# EasyEDA Pro project EKOPARTY_FINAL.eprj, board PCB1 (continued)
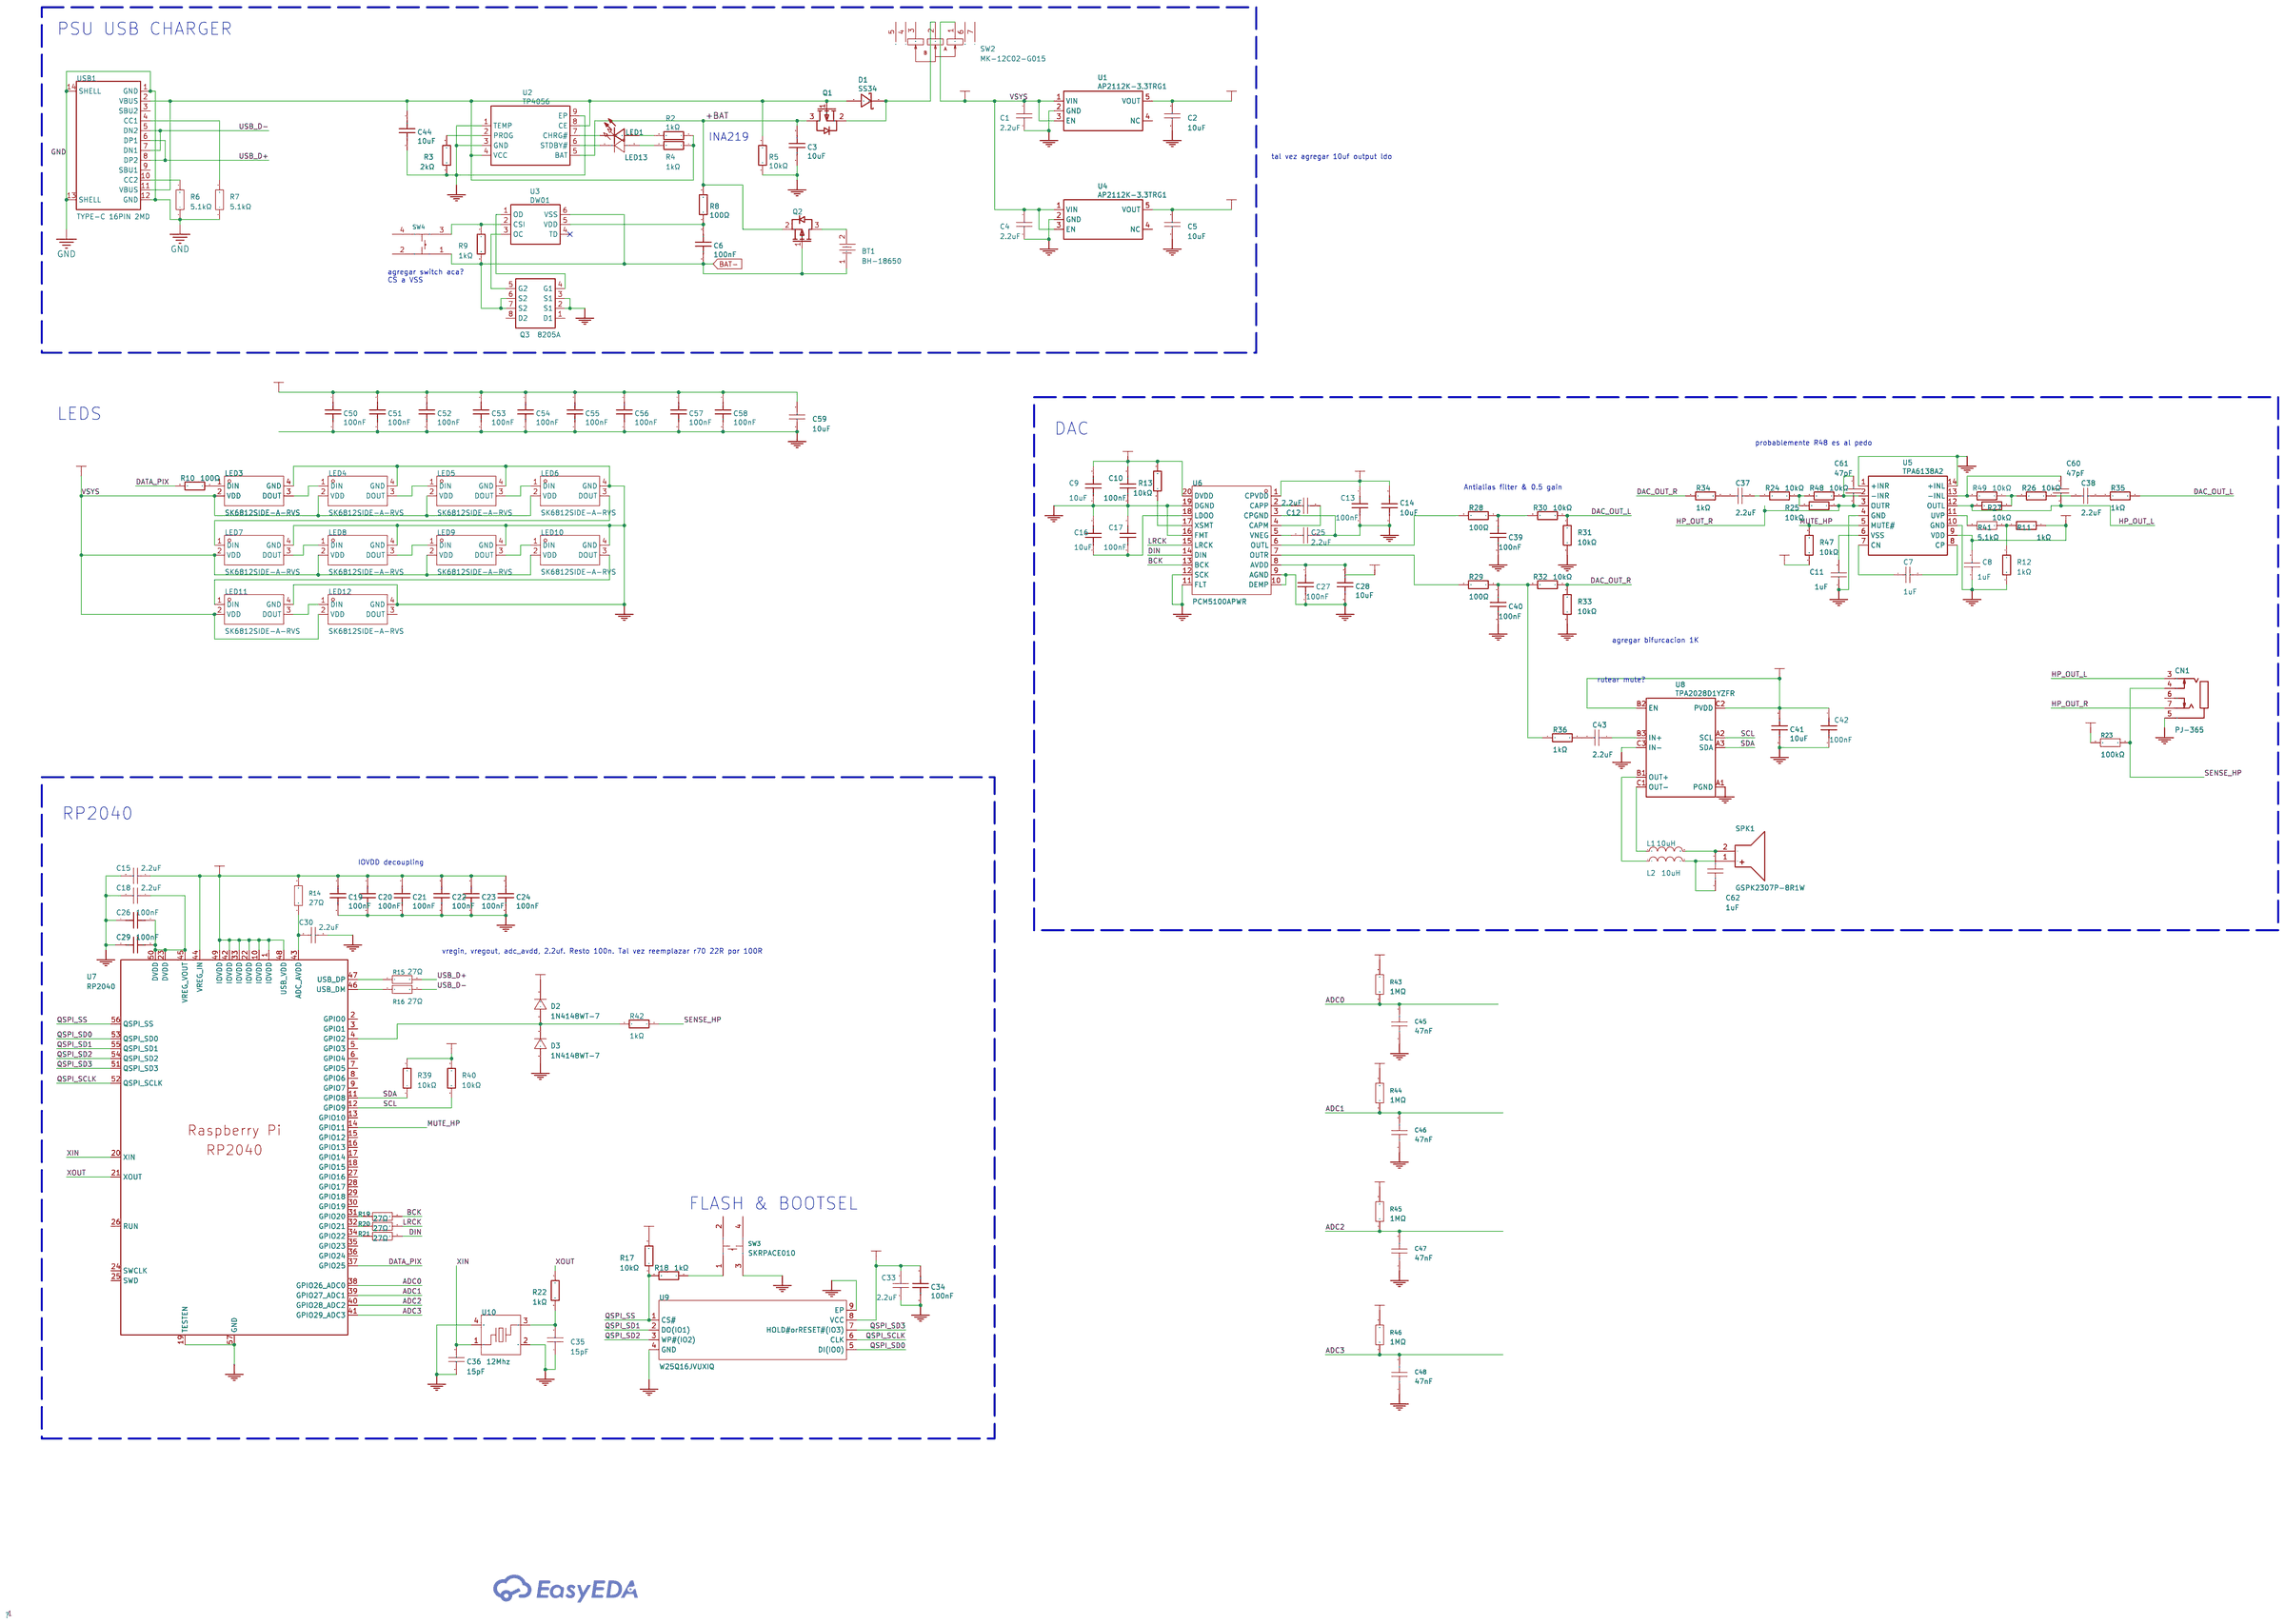
[diagram p0: schematic sheet]
## Nets
As in the schematic, except:
3.3V: C2.1 C9.2 C10.1 C13.1 C14.2 C15.1 C19.1 C20.1 C21.1 C22.1 C23.1 C24.1 C33.1 C34.1 D2.1 NOREF.TP1 R13.2 R14.2 R17.2 R23.2 R39.2 R40.1 R43.2 R44.2 R45.2 R46.2 R47.2 U1.5 U6.1 U6.20 U7.1 U7.10 U7.22 U7.33 U7.42 U7.44 U7.48 U7.49 U9.8
3.3VA: C5.1 C8.2 C27.1 C28.2 C41.2 C42.1 NOREF#7.TP2 NOREF#11.TP1 NOREF#16.TP2 R11.1 U4.5 U5.9 U6.8 U8.B2 U8.C2
GND: C1.2 C2.2 C3.1 C4.2 C5.2 C8.1 C9.1 C10.2 C11.1 C13.2 C14.1 C15.2 C16.2 C17.1 C18.2 C19.2 C20.2 C21.2 C22.2 C23.2 C24.2 C25.2 C26.1 C27.2 C28.1 C29.1 C30.1 C33.2 C34.2 C35.1 C36.1 C39.2 C40.2 C41.1 C42.2 C44.2 C45.1 C46.1 C47.1 C48.1 C50.2 C51.2 C52.2 C53.2 C54.2 C55.2 C56.2 C57.2 C58.2 C59.2 CN1.5 D3.2 LED3.4 LED4.4 LED5.4 LED6.4 LED7.4 LED8.4 LED9.4 LED10.4 LED11.4 LED12.4 NOREF#4.TP4 NOREF#20.TP7 Q3.2 Q3.3 R3.1 R5.1 R6.1 R7.1 R12.2 R31.2 R33.2 SW3.3 U1.2 U2.1 U2.3 U2.9 U4.2 U5.1 U5.4 U5.10 U5.14 U6.3 U6.9 U6.10 U6.11 U6.12 U6.16 U6.19 U7.19 U7.57 U8.A1 U8.C3 U9.4 U9.9 U10.2 U10.4 USB1.1 USB1.12 USB1.13 USB1.14
ADC0: C45.2 NOREF#21.TP8 NOREF#22.TP11 R43.1 U7.38
ADC1: C46.2 NOREF#12.TP15 R44.1 U7.39
ADC2: C47.2 NOREF#3.TP9 NOREF#23.TP9 R45.1 U7.40
ADC3: C48.2 NOREF#14.TP14 R46.1 U7.41
BCK: NOREF#2.TP5 R19.2 U6.13
DAC_OUT_L: NOREF#5.TP8 R30.1 R31.1 R35.2
DAC_OUT_R: NOREF#15.TP8 R32.1 R33.1 R34.1
DIN: NOREF#19.TP7 R21.2 U6.14
LRCK: NOREF#17.TP6 R20.2 U6.15
SCL: NOREF#18.TP9 R40.2 U7.12 U8.A2
SDA: NOREF#6.TP9 R39.1 U7.11 U8.A3
USB_D+: NOREF#10.TP1 R15.2 USB1.6 USB1.8
USB_D-: NOREF#13.TP2 R16.2 USB1.5 USB1.7
VSYS: C1.1 C4.1 C50.1 C51.1 C52.1 C53.1 C54.1 C55.1 C56.1 C57.1 C58.1 C59.1 LED3.2 LED4.2 LED5.2 LED6.2 LED7.2 LED8.2 LED9.2 LED10.2 LED11.2 LED12.2 NOREF#9.TP3 SW2.1 U1.1 U1.3 U4.1 U4.3
$1N11709: C40.1 NOREF#8.TP3 R29.1 R32.2 R36.1

Pads without a net: CN1 6; LED12 3; Q3 1 8; SW2 3 4 5 6 7; SW3 2 4; SW4 2 4; U1 4; U3 4; U4 4; U7 2 3 5 6 7 8 9 13 15 16 17 18 24 25 26 27 28 29 30 35 36; USB1 3 9

## Via types
v1: diameter 0.45, hole 0.3, Top Layer to Bottom Layer, 66 vias
v2: diameter 0.45, hole 0.2, Top Layer to Bottom Layer, 81 vias
v3: diameter 0.61, hole 0.305, Top Layer to Bottom Layer, 106 vias
v4: diameter 1, hole 0.5, Top Layer to Bottom Layer, 4 vias
v5: diameter 0.8, hole 0.4, Top Layer to Bottom Layer, 2 vias

## Routing (per net, layer and track width the routed paths; a pad name or vN(x,y) marks a point on that pad's centre or on a via; arc(x,y) is an arc through that point)
3.3V: length 172.5
  Inner1 w0.127: v2(86.06,77.14) 83.39,74.47 v2(82.12,74.47) ; v3(77.42,83.49) 77.42,81.08 v3(77.04,80.7) ; v2(87.45,71.59) 87.45,70.17 ; v2(92.15,72.06) 91.43,72.79 v4(91.43,73.59)
  Inner1 w0.5: v3(37.38,75.49) 41.19,71.68 58.75,71.68 59.77,70.66
  Inner1 w0.8: 78.27,70.28 77.78,70.78 59.88,70.78 59.77,70.66
  Inner1 w1: 78.27,70.28 v4(78.56,70.58) 78.99,70.16 88,70.16 v4(91.43,73.59)
  Inner2 w0.127: v2(93.55,84.38) 93.55,77.9 v3(92.15,76.51)
  Bottom Layer w0.127: 84.7,78.16 84.79,78.25 85,78.25 85.04,78.28 ; 84.7,78.16 84.55,78.31 84.55,78.67 84.43,78.79 80.98,78.79 80.6,78.41 v2(80.6,78.28) 80.41,78.1 U7.1 77.65,78.1 C19.1 ; 84.7,78.16 U7.44 84.7,76.47 85.04,76.13 86.25,76.13 86.25,76.1 C15.1 87.29,75.24 R14.2 ; 85.28,81.7 85.04,81.46 85.04,78.28 ; 85.28,81.7 85.18,81.7 84.28,82.6 82.88,82.6 82.63,82.86 82.63,83.24 82.7,83.31 U7.22 82.7,86.23 83.14,86.67 84.84,86.67 85.55,87.39 ; 85.28,81.7 U7.33 86.07,81.71 87.54,81.71 ; v2(92.15,72.06) 92.59,71.63 92.59,71.25 ; C20.1 77.2,82.18 76.71,82.68 R39.2 ; U7.49 82.75,77.1 82.75,75.95 ; v2(82.12,74.47) 81.96,74.47 C23.1 81.87,75.07 82.75,75.95 ; v2(86.06,77.14) 87.04,77.14 C24.1 ; 77.59,81.71 77.6,81.7 U7.10 ; 82.75,75.95 83.1,76.3 U7.48 ; C33.1 76.78,72.82 U9.8 ; R46.2 v2(87.45,71.59) ; 87.54,77.78 86.37,77.78 U7.42 85.98,78.03 85.3,78.03 85.04,78.28 ; v3(77.42,83.49) 77.42,83.95 R40.1 ; U1.5 92.89,75.77 v3(92.15,76.51) ; R43.2 94.26,83.92 93.8,84.38 v2(93.55,84.38) ; R47.2 74.26,83.15 D2.1 74.26,81.44 74.77,80.94 74.77,80.61 R23.2 75.19,80.7 v3(77.04,80.7) 77.19,80.54 77.59,80.54
  Bottom Layer w0.25: 77.59,81.71 77.59,80.54 77.3,80.26 77.3,78.31 C19.1 ; C10.1 32.96,77.75 C9.2 32.93,78.78 U6.20 31.75,78.79 R13.2 30.69,77.72 30.69,77.27 30.51,77.09 28.53,77.09 28.35,77.27 28.35,78.59 28.15,78.79 27.18,78.79 U6.1 25.39,78.79 C13.1 C14.2 ; R45.2 92.62,75.57 U1.5
  Bottom Layer w0.254: R17.2 75.52,72.91 C33.1 C34.1 ; v2(87.45,71.59) 88.38,71.59 NOREF.TP1
  Bottom Layer w0.5: C10.1 32.96,76.13 33.61,75.49 v3(37.38,75.49) ; v4(78.56,70.58) 78.1,71.05 76.02,71.05 75.52,71.55 C34.1 ; R14.2 88.16,74.65 89.23,73.59 v4(91.43,73.59) 92.89,75.04 U1.5 93.51,75.92 C2.1
3.3VA: length 67.5
  Inner1 w0.5: v3(37.54,86.16) 36.78,86.92 36.78,89.33 35,91.11 27.13,91.11 v3(26.88,90.86) 26.24,90.22 26.24,89.59 14.81,78.16 v3(14.81,73.46)
  Bottom Layer w0.127: U8.B2 U8.C2 41.35,86.79 ; R11.1 14.43,73.08 v3(14.81,73.46) 15.57,72.7 C8.2 15.89,72.92 U5.9
  Bottom Layer w0.25: U4.5 29.61,84.45 28.5,83.34 U6.8 27.15,83.36 26.15,83.36 C28.2 C27.1
  Bottom Layer w0.254: 39.74,86.06 39.74,85.61 NOREF#16.TP2 ; NOREF#11.TP1 37.92,85.78 v3(37.54,86.16) ; NOREF#7.TP2 v3(26.88,90.86) ; v3(41.86,86.16) 41.35,86.67 41.35,86.79
  Bottom Layer w0.5: v3(37.54,86.16) 38.58,86.16 38.68,86.06 41.76,86.06 v3(41.86,86.16) 41.86,85.69 41.23,85.05 C42.1 ; v3(26.88,90.86) 27,90.86 27,86.92 27.55,86.38 C5.1 29.49,86.38 U4.5
GND: length 32.8
  Top Layer w0.127: v2(49.23,21.13) 49.61,20.75 49.61,20.37 ; v2(46.31,17.83) 46.94,17.2 ; v2(44.41,17.58) 45.04,17.58 ; v2(59.9,21.13) 59.9,21.01 59.26,20.37 ; 59.9,25.2 59.9,23.83 v2(59.88,23.81) ; v2(62.94,17.71) 62.18,16.94 61.93,16.94
  Bottom Layer w0.127: v3(95.58,70.03) 95.58,68.15 94.91,67.48 ; 86.88,85.78 86.95,85.85 86.95,87.39 ; v3(21.03,73.97) 21.29,74.22 U5.4 ; C35.1 83.59,91.07 82.2,91.07 ; U5.14 17.14,76.13 v3(18.49,76.13) ; 80.72,80.7 v3(81.48,80.7) U7.57 ; U5.1 22.57,76.05 v3(21,76.05) ; U10.4 79.76,89.13 C36.1 ; U7.19 81.5,82.86
  Bottom Layer w0.25: USB1.12 50.81,6.83 USB1.14 ; U7.19 81.5,85.38 79.71,87.17 79.71,87.8 C36.1 ; USB1.13 58.34,7.38 USB1.1 ; 88.63,77.78 C30.1 89.55,76.63 v3(89.67,76.52) ; U6.12 U6.11
  Bottom Layer w0.254: Q3.2 84.1,43.87
  vias: v1(41.99,100.76) v1(42.88,100.76) v1(43.39,84.38) v1(43.51,89.21) v1(43.77,90.86) v1(44.02,83.49) v1(44.27,86.29) v1(44.4,92.89) v1(45.04,85.65) v1(45.04,82.73) v1(45.29,94.79) v1(46.05,82.22) v1(46.56,96.32) v1(46.56,81.46) v1(46.81,82.22) v1(47.45,84.38) v1(47.65,82.22) v1(48.08,97.59) v1(48.45,100.89) v1(48.47,82.22) v1(48.72,79.68) v1(49.74,98.6) v1(50.18,100.89) v1(50.37,78.79) v1(51.13,99.24) v1(52.05,100.89) v1(52.28,78.16) v1(53.33,99.87) v1(53.97,100.89) v1(54.56,82.35) v1(54.69,84.38) v1(54.82,77.9) v1(55.32,99.87) v1(55.83,84.51) v1(55.83,82.35) v1(55.88,100.89) v1(56.59,85.14) v1(56.85,82.48) v1(57.1,99.62) v1(57.61,86.16) v1(57.74,83.11) v1(57.74,78.28) v1(57.79,100.89) v1(58.5,87.05) v1(58.63,99.11) v1(58.63,84) v1(59.13,100.89) v1(59.64,85.02) v1(59.77,79.05) v1(60.02,98.48) v1(60.66,87.31) v1(60.66,86.03) v1(60.78,100.89) v1(61.67,80.32) v1(61.93,97.08) v1(62.94,96.19) v1(63.2,81.84) v1(63.83,94.92) v1(64.47,83.75) v1(64.59,93.52) v1(65.23,85.52) v1(65.36,91.75) v1(65.61,87.3) v1(65.74,89.59) v1(66.75,100.76) v1(68.53,100.76) v2(3.89,63.17) v2(5.29,54.79) v2(8.18,39.42) v2(9.03,39.42) v2(9.35,27.23) v2(9.98,75.49) v2(13.67,84.25) v2(14.68,20.75) v2(21.92,93.52) v2(22.3,42.47) v2(30.18,71.93) v2(33.1,100) v2(36.15,45.26) v2(44.15,45.26) v2(45.67,72.57) v2(46.18,2.72) v2(49.99,96.19) v2(53.55,72.44) v2(55.2,80.95) v2(57.48,46.28) v2(60.15,95.81) v2(62.56,71.55) v2(63.58,85.65) v2(63.91,2.63) v2(65.36,96.83) v2(69.04,78.28) v2(69.8,71.68) v2(72.34,84.51) v2(76.79,91.24) v2(76.79,90.22) v2(76.79,89.16) v2(77.17,92.38) v2(77.93,92.89) v2(78,89.16) v2(78.83,92.89) v2(79.33,86.41) v2(79.84,92.89) v2(80.34,85.78) v2(80.85,92.89) v2(83.39,10.21) v2(84.28,88.57) v2(85.2,88.57) v2(85.68,94.29) v2(85.68,89.97) v2(85.8,88.95) v2(86.44,93.65) v2(87.2,93.02) v2(97.36,22.79) v3(20.65,80.44) v3(24.46,83.24) v3(34.11,84) v3(42.62,103.56) v3(44.2,103.56) v3(63.45,40.95) v3(66.12,103.68) v3(66.52,41.07) v3(66.84,37.01) v3(67.4,41.07) v3(67.47,103.68) v3(68.28,41.07) v3(79.05,75.85) v3(79.83,72.57) v3(81.49,81.84) v3(81.49,79.68) v3(82.43,81.84) v3(82.43,80.7) v3(82.43,79.67) v3(83.4,81.85) v3(83.4,80.7) v3(83.4,79.65) v3(86.18,41.07) v3(87.33,73.2) v3(96.6,34.6) v3(99.42,70.03)
+BAT: length 48.3
  Bottom Layer w0.127: U2.5 65.42,43.89
  Bottom Layer w0.5: 63.92,43.61 62.94,43.61 ; U2.5 65.05,43.65 63.96,43.65
  Bottom Layer w0.6: Q2.2 74.39,40.12 R8.2
  Bottom Layer w1: 72.34,34.91 71.74,34.3 63.54,34.3 62.24,35.61 62.24,42.91 62.94,43.61 ; 72.34,34.91 73.05,35.61 73.05,40.08 Q2.2 ; 72.34,34.91 72.34,34.34 85.15,34.34 87.34,36.53 Q1.3 ; 63.96,43.65 63.92,43.61
ADC0: length 78.8
  Top Layer w0.254: 101.68,25.2 101.68,25.71 v3(100.15,27.23)
  Inner1 w0.2: 96.56,78.28 96.11,78.73 v2(93.11,78.73)
  Inner1 w0.25: v3(95.71,80.82) 96.56,79.98
  Inner1 w0.254: 96.56,79.98 96.56,78.28
  Inner1 w0.5: 96.56,78.28 98.25,78.28 104.6,71.93 104.6,34.47 103.71,33.58 v3(102.44,33.58)
  Bottom Layer w0.127: v2(93.11,78.73) 92.79,79.05 91.86,79.05 91.48,79.43 87.84,79.43 87.57,79.7 U7.38 ; R43.1 95.71,82.78 v3(95.71,80.82) ; NOREF#22.TP11 NOREF#21.TP8
  Bottom Layer w0.5: NOREF#22.TP11 101.04,29.3 101.04,28.12 v3(100.15,27.23) ; C45.2 95.62,80.91 v3(95.71,80.82) ; NOREF#21.TP8 v3(102.44,33.58)
ADC1: length 87.9
  Top Layer w0.127: v2(59.92,26.13) 59.92,27.96 59.77,28.12 ; v2(53.16,26.34) 53.16,27.87
  Inner1 w0.25: 60.26,26.47 63.45,26.47
  Inner1 w0.254: 60.26,26.47 v2(59.92,26.13) 59.71,26.34 v2(53.16,26.34)
  Inner1 w0.5: 63.45,26.47 v2(64.55,26.47)
  Inner2 w0.25: v2(90.88,78.16) 90.38,77.65 90.38,74.31
  Inner2 w0.5: v2(64.55,26.47) 65.48,26.47 87.96,48.95 87.96,62.92 90.38,65.33 v2(90.38,70.54) 90.38,72.86 89.95,73.29 89.95,73.88 90.38,74.31
  Bottom Layer w0.127: 91.77,78.28 91.65,78.16 v2(90.88,78.16) 90.88,78.28 90.12,79.05 87.84,79.05 87.58,79.3 U7.39 ; v2(90.38,70.54) 91.09,70.54 R44.1
  Bottom Layer w0.25: C46.2 91.72,70.81 R44.1
ADC2: length 155.6
  Top Layer w0.254: 25.73,11.1 22.68,8.05 21.8,8.05
  Inner2 w0.5: v3(30.3,11.1) 62.82,11.1 67.77,6.15 77.17,6.15 103.46,32.44 103.46,68.89 100.67,71.67 100.45,71.67 100.14,71.97 100.14,72.2 v3(98.25,74.09) v3(94.57,77.78)
  Bottom Layer w0.127: U7.40 87.66,78.9 87.79,78.77 89.43,78.77 90.93,77.27 92.53,77.27 93.04,77.78 v3(94.57,77.78) ; NOREF#23.TP9 NOREF#3.TP9
  Bottom Layer w0.25: R45.1 91.26,77.25 91.25,77.27 ; v3(98.25,74.09) 97.78,73.62 C47.2
  Bottom Layer w0.5: NOREF#3.TP9 v3(30.3,11.1)
  vias: v3(25.86,11.1)
ADC3: length 103
  Top Layer w0.127: 52.78,18.47 52.15,17.83 v2(51.51,17.83)
  Top Layer w0.25: 54.56,16.69 54.56,18.72
  Inner1 w0.127: 51.39,17.96 v2(51.51,17.83)
  Inner1 w0.254: 50.24,25.83 51.39,24.69 51.39,17.96
  Inner1 w0.5: v3(64.34,30.91) 64.34,29.97 62.74,28.37 51.26,28.37 50.24,27.36 50.24,25.83
  Inner2 w0.5: 84.53,71.55 v2(85.17,71.55) ; 84.53,71.55 84.53,74 88.12,77.59 v2(89.77,77.59) ; 84.53,71.55 v2(84.53,69.01) 84.53,67.36 v2(84.15,66.98) 83.14,65.97 76.91,65.97 76.41,65.46 76.41,54.79 78.82,52.38 78.82,48.57 72.98,42.72 72.98,37.9 72.38,37.3 72.38,36.68 66.62,30.91 v3(64.34,30.91)
  Bottom Layer w0.127: C48.2 85.75,69.01 v2(84.53,69.01) ; NOREF#14.TP14 85.3,66.98 v2(84.15,66.98) ; v2(89.77,77.59) 88.95,78.41 87.07,78.41 86.99,78.5 U7.41 ; R46.1 85.9,71.55 v2(85.17,71.55)
BAT-: length 88.3
  Inner1 w1: 71.33,42.34 v3(56.21,42.34)
  Inner1 w2: v3(56.21,42.34) 47.2,42.34 31.7,26.85 19.69,26.85 BT1.1 ; v3(71.58,42.09) 75.52,38.15 v3(79.07,38.15)
  Bottom Layer w0.127: Q3.7 84.1,38.02
  Bottom Layer w0.25: SW4.1 59.46,40.75 57.86,42.34 v3(56.21,42.34)
  Bottom Layer w0.5: 74.51,42.39 74.4,42.5 74.75,42.85 76.59,42.85 77.29,42.15 77.5,42.36 R9.2 ; 74.51,42.09 74.51,41.89 ; Q2.1 73.02,42.09 v3(71.58,42.09)
  Bottom Layer w1: Q2.1 74.05,42.02 74.25,42.22 ; 83.78,38.02 83.78,36.13
  Bottom Layer w1.5: 83.64,36.25 83.52,36.12 81.74,36.12 79.74,38.12 v3(79.74,38.15)
  Bottom Layer w2: v3(79.07,38.15) v3(79.74,38.15)
  vias: v3(55.7,42.99) v3(55.7,41.71) v3(70.82,42.09) v3(71.58,42.85) v3(79.07,38.91) v3(79.07,37.39)
BCK: length 88.8
  Inner1 w0.25: v3(90.38,85.52) 90.38,92.64 86.44,96.57 v3(83.26,96.57)
  Bottom Layer w0.25: v3(90.38,85.52) 90.38,85.47 R19.2 ; v3(83.26,96.57) 76.86,102.98 40.01,102.98 36.4,99.37 36.4,84.51 35.26,83.36 32.95,83.36 U6.13
  Bottom Layer w0.254: v3(90.38,85.52) 89.99,85.9 NOREF#2.TP5
DAC_OUT_L: length 5
  Bottom Layer w0.25: R30.1 18.57,82.48 R31.1 R35.2
  Bottom Layer w0.254: R35.2 15.14,82.27 NOREF#5.TP8
DAC_OUT_R: length 10.2
  Inner2 w0.25: v3(17.1,84.25) 19.76,81.59 v3(19.76,79.68)
  Bottom Layer w0.25: R32.1 R33.1 17.1,84.81 v3(17.1,84.25) ; R34.1 19.76,78.95 v3(19.76,79.68)
  Bottom Layer w0.254: NOREF#15.TP8 16.59,85.47 R33.1
DATA_PIX: length 6.3
  Bottom Layer w0.127: U7.37 87.55,80.1 87.84,79.81 R10.2
DIN: length 99.4
  Inner2 w0.25: v3(92.92,80.7) 92.92,89.07 79.44,102.54 38.18,102.54 36.02,100.38 36.02,87.81 33.31,85.1 32.04,85.1 31.91,84.97 31.41,84.97 31.14,84.7 v3(31.14,83.02)
  Bottom Layer w0.127: R21.2 89.03,80.7 v3(92.92,80.7) ; v3(31.14,83.02) 31.47,82.69 32.92,82.69
  Bottom Layer w0.254: NOREF#19.TP7 92.92,80.82 v3(92.92,80.7)
HP_OUT_L: length 65.1
  Inner2 w0.25: v3(11.25,37.9) 11.25,38.41 6.05,43.61 5.03,43.61 2.24,46.41 2.24,66.73 6.56,71.05 16.21,71.05 18.75,73.59 v3(18.75,74.35)
  Bottom Layer w0.127: 17.89,77.48 18.41,77.48 19.38,76.51 19.38,74.98 v3(18.75,74.35)
  Bottom Layer w0.25: v3(11.25,37.9) 11.25,37.77 12.63,36.4 CN1.3 ; v3(18.75,74.35) 18.22,74.87 15.26,74.87 R27.2
HP_OUT_R: length 62.8
  Inner1 w0.25: v3(3.44,48.12) 2.75,48.82 2.75,66.22 8.21,71.68 17.34,71.68 v3(20.53,74.87)
  Bottom Layer w0.127: C61.1 26.06,72.7 25.3,73.46 R25.1
  Bottom Layer w0.25: v3(20.53,74.87) 24.65,74.87 R25.1 ; v3(3.44,48.12) 3.44,44.95 6.81,41.58 11.64,41.58 13.03,42.98 CN1.7
LRCK: length 91.6
  Inner2 w0.25: v3(91.15,82.96) 91.8,83.61 91.8,85.77 92.28,86.25 92.28,88.7 80.36,100.62 79.37,100.62 79.31,100.56 78.83,100.56 77.99,101.4 39.08,101.4 36.78,99.1 36.78,82.98 35.89,82.09 v3(35,82.09)
  Bottom Layer w0.25: v3(35,82.09) 32.98,82.09 U6.15 ; v3(91.15,82.96) R20.2
  Bottom Layer w0.254: NOREF#17.TP6 v3(91.15,82.96)
MUTE_HP: length 64
  Inner1 w0.127: v2(24.21,73.59) 24.22,73.57 v2(30.26,73.57) ; v2(73.23,84.13) 73.6,84.49 75.99,84.49 76.29,84.8 76.29,85.03 76.66,85.4 v2(78.82,85.4)
  Inner1 w0.25: v3(40.72,73.59) 40.97,73.33 58.37,73.33 68.28,83.24 v3(71.71,83.24)
  Bottom Layer w0.127: U5.5 22.71,73.59 v2(24.21,73.59) ; v2(78.82,85.4) 78.95,85.26 U7.14 ; v2(73.23,84.13) 73.23,83.42 R47.1 73.05,83.24 v3(71.71,83.24)
  Bottom Layer w0.254: v3(40.72,73.59) 40.7,73.57 v2(30.26,73.57)
QSPI_SCLK: length 7.4
  Bottom Layer w0.127: U9.6 77.8,72.45 78.06,72.19 78.44,72.19 78.69,72.44 78.69,73.46 81.5,76.27 U7.52
QSPI_SD0: length 5.5
  Bottom Layer w0.127: U7.53 81.1,76.25 78.31,73.46 78.31,72.85 U9.5
QSPI_SD1: length 4.6
  Bottom Layer w0.127: U7.55 80.3,76.47 80.09,76.25 79.71,76.25 79.2,76.76 77.81,76.76 77.3,76.25 U9.2
QSPI_SD2: length 4.3
  Bottom Layer w0.127: U7.54 80.62,77.06 80.62,76.46 80.18,76.02 79.61,76.02 79.26,76.38 77.93,76.38 77.8,76.25 U9.3
QSPI_SD3: length 8.4
  Bottom Layer w0.127: U7.51 81.9,76.29 78.92,73.31 78.92,72.35 78.51,71.93 77.8,71.93 77.3,72.44 U9.7
QSPI_SS: length 6.8
  Bottom Layer w0.127: R18.2 75.52,76.05 R17.1 75.85,74.91 U9.1 76.79,75.87 76.79,76.25 77.68,77.15 U7.56
SCL: length 72.3
  Inner1 w0.25: v3(41.35,99.11) 41.35,103.68 42.24,104.57 67.77,104.57 70.18,102.16 70.18,89.33 74.5,85.02 v3(75.77,85.02)
  Bottom Layer w0.127: R40.2 75.82,85.07 v3(75.77,85.02) ; U8.A2 41.35,89.33
  Bottom Layer w0.25: 41.35,89.33 v3(41.35,99.11) ; U7.12 78.18,82.5 78.09,82.59 78.09,84.47 77.5,85.07 R40.2
  Bottom Layer w0.5: v3(75.77,85.02) 75.77,85.78 NOREF#18.TP9
SDA: length 67.4
  Bottom Layer w0.127: U8.A3 40.85,88.32 40.85,89.59
  Bottom Layer w0.25: 72.88,88.09 72.88,86.69 R39.1 76.33,83.24 76.79,83.24 77.93,82.1 U7.11 ; 40.85,89.59 40.11,90.32 v3(40.11,96.83)
  Bottom Layer w0.254: v3(40.11,96.83) 40.08,96.85 40.08,100.89 41.1,101.91 69.67,101.91 72.88,98.7 72.88,88.09
SENSE_HP: length 112.8
  Bottom Layer w0.127: R42.2 73.05,80.44 R23.1
  Bottom Layer w0.25: CN1.4 2.62,41.68 2.62,67.62 4.9,69.9 46.69,69.9 50.62,73.84 62.44,73.84 69.17,80.57 72.77,80.57 R42.2
USB_D+: length 95.9
  Bottom Layer w0.127: USB1.8 53.81,8.19 53.93,8.31 54.43,8.31 54.81,7.93
  Bottom Layer w0.254: 54.86,12.55 54.86,37.03 53.39,38.49 53.39,51.66 55.68,53.94 55.68,55.34 56.81,56.47 56.81,64.15 56.31,64.65 56.31,65.88 60.24,69.8 82.76,69.8 83.57,70.62 83.57,73.14 R15.2 ; 54.86,12.55 54.86,8.23 54.81,8.18 USB1.6 ; 54.86,12.55 NOREF#10.TP1
USB_D-: length 96.6
  Bottom Layer w0.127: USB1.5 55.31,6.64 55.07,6.4 54.43,6.4 54.31,6.53 54.31,7.38 USB1.7
  Bottom Layer w0.254: 55.26,12.55 55.26,37.2 53.8,38.66 53.8,51.49 56.09,53.77 56.09,55.17 57.22,56.31 57.22,64.32 56.72,64.82 56.72,65.71 60.4,69.39 82.92,69.39 83.98,70.45 83.98,73.14 R16.2 ; 55.26,12.55 NOREF#13.TP2 ; 55.26,12.55 55.26,8.23 55.31,8.18 USB1.5
VSYS: length 218
  Inner1 w0.8: v4(102.19,68.76) 101.94,69.01 99.22,69.01 99.15,68.95 98.36,68.95 98.3,69.01 90.2,69.01 89.19,68 78.05,68 76.92,69.14 58.76,69.14 57.48,70.41 v3(52.66,70.41)
  Inner1 w1: v3(8.59,69.01) 9.22,69.65 24.84,69.65 26.62,67.87 28.72,67.87 v3(29.61,68.76) 30.63,69.78 37.33,69.78 38.05,69.06 ; 38.05,69.06 38.35,69.06 38.48,69.18 47.99,69.18 49.22,70.41 v3(52.66,70.41) ; 38.05,69.06 38.05,72.06 36.15,73.97 36.15,85.78 v3(32.59,89.33)
  Bottom Layer w0.127: C58.1 100.24,41.16 v3(100.28,41.2) ; C55.1 39.79,45.14 v3(39.07,45.14) ; C54.1 19.22,41.49 v3(19.26,41.45) ; v3(60.02,45.9) 60.24,46.12 C56.1 ; v3(81.36,43.87) 81.36,44.97
  Bottom Layer w0.25: LED5.2 51.58,69.34 v3(52.66,70.41) ; U4.3 31.51,87.87 31.32,87.68 29.8,87.68 29.54,87.94 29.54,88.79 U4.1 ; v3(8.59,69.01) 8.97,69.01 LED7.2 ; 97.03,66.71 97.28,66.97 97.28,71.1 97.35,71.17 ; U1.1 95.42,75.24 94.69,75.24 94.19,74.73 94.19,73.84 94.63,73.4 U1.3 95.49,73.07 C1.1 95.46,71.34 95.46,71.17 ; v3(78.06,67.87) 72.85,67.87 71.83,66.85 71.83,65.91 LED4.2 ; LED6.2 v3(29.61,68.76)
  Bottom Layer w0.254: v3(52.66,70.41) 53.71,70.41 C51.1 ; 98.63,43.49 98.5,43.36 98.5,42.22 ; C56.1 60.24,48.39 LED10.2 ; v3(32.59,89.33) NOREF#9.TP3 ; v3(29.61,68.76) 30.52,68.76 C52.1 ; C57.1 81.8,45.41 LED11.2 ; 73.16,67.87 73.16,67.83 73.74,67.25 ; v4(102.19,68.76) 102.19,68.34 C59.1 ; LED8.2 18.37,43.28 C54.1 ; C53.1 7.41,68.89 8.46,68.89 v3(8.59,69.01) ; C55.1 40.27,45.61 LED9.2 ; 98.5,42.21 LED12.2 99.08,41.35 C58.1
  Bottom Layer w0.5: C4.1 31.91,87.47 31.51,87.87 ; U4.3 31.99,89.33 v3(32.59,89.33) ; 98.88,43.74 98.94,43.68
  Bottom Layer w1: 103.71,58.09 101.68,56.06 101.68,50.6 102.82,49.46 102.82,47.15 101.82,46.15 101.3,46.15 98.88,43.74 ; 103.71,58.09 103.71,67.24 v4(102.19,68.76) 99.77,71.17 95.46,71.17 ; 103.71,58.09 105.05,58.09 SW2.1
XIN: length 8.5
  Bottom Layer w0.127: 80,91.07 81.1,89.97 81.1,88.11 80.86,87.86 81.24,87.86 81.68,87.41 81.68,87.15 81.9,86.93 81.9,83.74
XOUT: length 3.4
  Bottom Layer w0.127: U7.21 82.3,84.25 82.3,87.67
$1N2546: length 6.5
  Bottom Layer w0.25: Q3.4 84.75,42.72
  Bottom Layer w0.5: 79.59,42.15 84.17,42.15 84.75,42.72
$1N2547: length 6.8
  Bottom Layer w0.25: 84.75,39.21 Q3.5
  Bottom Layer w0.5: U3.3 83.71,40.25 84.75,39.21
$1N2549: length 30
  Bottom Layer w0.127: U3.2 78.82,41.2 78.69,41.33 78.69,43.16 R9.1 78.36,43.94 75.54,46.76 63.42,46.76 61.17,44.5 61.17,38.6 61.04,38.47 60.34,38.47 SW4.3
$1N2552: length 3.3
  Bottom Layer w0.127: R8.1 75.7,41.98
  Bottom Layer w0.5: C6.1 76.7,41.2 U3.5
$1N2554: length 123.1
  Inner1 w1: v5(63.83,37.9) 65.61,36.12 v4(65.61,20.88)
  Inner1 w2: v3(98.38,37.52) 100.54,35.36 100.54,32.39 98.68,30.53 v3(98.5,30.53)
  Bottom Layer w0.127: 66.27,42.52 65.59,42.52 65.46,42.4 65.46,38.24 U2.4 ; 66.27,42.52 68.61,42.52 69.23,43.14 U2.8 69.75,44.02 70.94,45.21 ; 66.27,42.52 65.99,42.8 65.99,44.63 65.94,44.68 65.94,44.7 65.65,44.99 R4.1 ; C44.1 63.96,39.89 63.83,39.77 v5(63.83,37.9)
  Bottom Layer w0.25: USB1.2 56.96,6.7 56.82,6.56 56.82,6.38 56.59,6.15 56.59,5.39 56.34,5.13 53.42,5.13 53.04,5.51 53.04,5.77 52.3,6.51 52.3,6.56 52.28,6.58 52.28,7.01 52.16,7.13 USB1.11 ; D1.2 94.23,35.61 R5.2
  Bottom Layer w0.5: 58.11,9.49 56.96,8.34 USB1.2 ; 56.97,7.39 56.96,7.4
  Bottom Layer w0.8: v5(63.83,37.9) 64.13,38.2 U2.4
  Bottom Layer w1: 58.11,9.49 58.79,9.49
  Bottom Layer w1.5: v3(98.38,37.52) 96.05,37.52 D1.2 94.19,36.76 91.08,39.86 Q1.1
  Bottom Layer w2: v3(98.5,30.53) 88.85,20.88 v4(65.61,20.88) 65.61,16.31 58.79,9.49
  vias: v3(97.87,37.14) v3(98,31.04) v3(98.88,37.9) v3(99.01,30.02)
$1N2555: length 3.4
  Bottom Layer w0.127: R4.2 64.57,46.53 66.15,46.53 LED13.2
$1N2556: length 1.3
  Bottom Layer w0.127: LED1.2 70.77,45.9 R2.2
$1N2557: length 2.5
  Bottom Layer w0.127: U2.6 66.69,44.4 LED13.1
$1N2558: length 1.9
  Bottom Layer w0.127: LED1.1 68.11,44.17 U2.7
$1N2560: length 5.2
  Bottom Layer w0.127: R3.2 70.56,38.48 70.31,38.23 70.31,37.77 69.42,36.88 68.28,36.88 67.96,37.2 U2.2
$1N4366: length 6.6
  Bottom Layer w0.127: R6.2 48.72,7.67 49.69,8.64 52.35,8.64 52.81,8.18 USB1.10
$1N4379: length 8.5
  Inner2 w0.127: v3(60.28,4.62) 60.06,4.41 56.17,4.41 55.83,4.75 v2(55.83,5.86)
  Bottom Layer w0.127: USB1.4 55.83,7.36 v2(55.83,5.86)
  Bottom Layer w0.25: v3(60.28,4.62) 60.28,5.59 R7.2
$1N5069: length 4.2
  Bottom Layer w0.127: 83.81,87.67 83.81,87.77 U10.3 83.59,89.37 C35.2
$1N5247: length 2.5
  Bottom Layer w0.127: U7.47 83.5,76.11 83.01,75.62 83.01,74.89 83.01,74.89
$1N5251: length 2.5
  Bottom Layer w0.127: 84.54,74.89 84.54,75.61 83.9,76.25 83.9,77.14 U7.46
$1N5714: length 23.2
  Inner1 w0.127: v2(82.3,78.16) 82.81,78.67 83.52,78.67 84.22,79.36 84.22,82.92 84.16,82.98 v2(84.16,83.11)
  Bottom Layer w0.127: 86.18,74.79 85.36,75.62 84.91,75.62 84.3,76.23 U7.45 84.3,78.01 84.15,78.16 v2(82.3,78.16) U7.50 82.3,75.83 81.38,74.91 81.38,74.41 C26.2 ; v2(84.16,83.11) 83.39,83.11 83.14,83.36 83.14,84.21 U7.23 83.1,85.11 83.77,85.78 85.61,85.78
$1N5982: length 5.3
  Bottom Layer w0.127: 87.45,76.51 85.74,76.51 U7.43 ; 87.45,76.51 87.45,76.54 C30.2 ; 87.45,76.51 87.45,76.13 87.71,75.87 88.72,75.87 89.03,75.57 R14.1
$1N6481: length 3.7
  Bottom Layer w0.127: R18.1 70.95,76.13 SW3.1
$1N6520: length 24.3
  Bottom Layer w0.25: 96.06,67.06 96.06,66.83 95.84,66.6 95.84,66.33 94.71,65.2 73.75,65.2 LED4.1
$1N6526: length 22.6
  Inner1 w0.25: v3(56.72,69.27) 57.99,68 v3(71.71,68)
  Bottom Layer w0.25: LED4.3 70.75,67.04 v3(71.71,68) ; 52.93,67.48 53.19,67.73 53.69,67.73 55.23,69.27 v3(56.72,69.27)
$1N6533: length 22.3
  Inner1 w0.25: v3(36.91,68.23) 44.42,68.23 v3(44.91,67.74)
  Bottom Layer w0.25: v3(36.91,68.23) 34.35,68.23 32.07,65.95 LED6.1 ; 50.56,67.5 50.56,68.45 50.12,68.89 46.05,68.89 v3(44.91,67.74)
$1N6540: length 19.6
  Bottom Layer w0.25: LED6.3 28.59,67.18 26.49,69.27 12.19,69.27 LED7.1
$1N6546: length 62
  Inner2 w0.25: v3(17.1,38.53) 20.14,38.53 21.67,40.06 21.67,47.17 23.45,48.95 23.45,51.49 22.18,52.76 22.18,64.82 24.76,67.4 24.76,69.32 24.51,69.57 9.65,69.57 9.17,69.09 9.17,68.77 8.83,68.43 8.51,68.43 v3(7.7,67.62)
  Bottom Layer w0.25: v3(7.7,67.62) 7.83,67.62 8.51,66.93 9.6,66.93 LED7.3 ; v3(17.1,38.53) 17.1,42.97 17.07,42.99
$1N6553: length 24.4
  Bottom Layer w0.25: LED8.3 19.51,43.55 19.51,42.47 20.7,41.28 34.28,41.28 39.05,46.04 39.05,47.05 38.92,47.18
$1N6560: length 23
  Inner1 w0.25: v3(59.01,46.41) 57.23,44.63 v3(41.35,44.63)
  Bottom Layer w0.25: LED9.3 41.29,44.69 v3(41.35,44.63)
  Bottom Layer w0.254: LED10.1 59.01,48.3 v3(59.01,46.41)
$1N6566: length 21.7
  Bottom Layer w0.25: 61.23,48.43 61.12,48.54 61.12,49.41 61.29,49.58 63.07,49.58 64.29,48.36 72.8,48.36 73.87,47.3 79.7,47.3 LED11.1
$1N6572: length 19.5
  Bottom Layer w0.25: LED11.3 82.82,47.25 83,47.42 84.91,47.42 86.06,46.28 86.06,45.14 89.99,41.2 97.61,41.2 98.11,40.7
$1N6927: length 2
  Bottom Layer w0.127: C12.1 25.77,79.55 27.06,79.55 U6.2
$1N6981: length 1.8
  Bottom Layer w0.127: U6.5 27.12,81.33 C25.1
$1N7021: length 3.4
  Bottom Layer w0.127: C12.2 24.3,80.28 24.76,80.74 U6.4
$1N7276: length 3.2
  Bottom Layer w0.25: C17.2 35.12,80.03 C16.1 32.95,80.06 U6.18
$1N7511: length 5.1
  Bottom Layer w0.127: R29.2 22.99,83.44 23.19,83.24 23.57,83.24 24.12,82.69 27.18,82.69
$1N7565: length 5.5
  Bottom Layer w0.25: R13.1 29.87,79.88 30.69,80.7 32.88,80.7 U6.17
$1N7694: length 2.9
  Bottom Layer w0.127: R19.1 88.16,83.95 86.71,82.5 U7.31
$1N7745: length 2.4
  Bottom Layer w0.127: R20.1 87.81,82.96 86.95,82.1 U7.32
$1N7820: length 2.3
  Bottom Layer w0.127: U7.34 86.09,81.33 86.82,81.33 87.58,80.57 R21.1
$1N7980: length 2.8
  Bottom Layer w0.254: U5.7 21.34,70.92 C7.1
$1N7985: length 2.8
  Bottom Layer w0.254: U5.8 18.44,70.92 C7.2
$1N8059: length 2.1
  Bottom Layer w0.25: U5.6 23.77,72.92 C11.2
$1N8912: length 19.2
  Inner1 w0.25: v3(100.66,73.59) 98.5,71.43 v3(98.5,70.03)
  Bottom Layer w0.25: v3(98.5,70.03) 98.54,69.99 98.54,66.61 LED3.1 ; v3(100.66,73.59) 100.66,74.98 96.09,79.55 93.35,79.55 R10.1
$1N9113: length 26.4
  Inner1 w1: v5(71.58,37.01) 82.12,26.47 BT1.2
  Bottom Layer w0.5: Q2.3 71.58,40.58 v5(71.58,37.01)
$1N11147: length 4.3
  Bottom Layer w0.127: R28.2 23.45,82.35 23.76,82.04 U6.6
$1N11253: length 3.9
  Bottom Layer w0.25: 25.22,76.43 25.15,76.51 24.08,76.51 23.57,77.01 23.25,77.01 22.76,77.51 21.94,77.51 C37.1
$1N11485: length 1.1
  Bottom Layer w0.25: C38.2 17.01,79.05 R26.1
$1N11610: length 2.9
  Bottom Layer w0.127: R30.2 20.82,82.46 C39.1 21.11,81.33 22.12,82.35
$1N11709: length 7.7
  Bottom Layer w0.127: 19.42,85.4 19.48,85.4 20.47,86.39 R36.1 19.33,87.81 NOREF#8.TP3 ; 19.42,85.4 C40.1 22,84.13 22.12,84 ; 19.42,85.4 18.42,85.4
$1N12142: length 2.5
  Bottom Layer w0.127: C43.1 40.68,87.81 U8.B3
$1N12188: length 10.1
  Bottom Layer w0.127: U8.C1 42.37,86.79 43.13,86.79
  Bottom Layer w0.7: L1.1 45.82,83.35 43.13,86.03 43.13,86.79
$1N12193: length 5.5
  Bottom Layer w0.127: U8.B1 43,87.81
  Bottom Layer w0.7: 46.46,86.22 44.88,87.81 43,87.81
  Bottom Layer w1: 46.46,86.22 L2.1
$1N21898: length 1.3
  Bottom Layer w0.25: R34.2 20.73,78.85 C37.2
$1N21938: length 1.2
  Bottom Layer w0.25: R35.1 17.22,80.35 C38.1
$1N21976: length 23.8
  Inner1 w0.254: v3(38.18,91.87) 21.8,91.87 v3(21.03,91.11)
  Bottom Layer w0.254: R36.2 21.03,86.97 v3(21.03,91.11) ; C43.2 39.07,90.98 v3(38.18,91.87)
$1N22177: length 4.5
  Bottom Layer w0.127: R27.1 R49.1 14.38,78.28 R26.2
$1N22211: length 7.8
  Bottom Layer w0.127: R24.1 26.93,76.38 R48.2 27.55,75.83 29.2,75.83 29.29,75.74 29.29,74.73 28.78,74.22 R25.2
$1N22282: length 3.9
  Bottom Layer w0.127: R41.2 U5.11
$1N22285: length 2.4
  Bottom Layer w0.127: R11.2 12.6,73.97 R41.1 11.33,74.22 R12.1
$1N22489: length 13.2
  Inner1 w0.127: v2(77.93,79.3) 77.68,79.55 v3(76.15,79.55) 76.15,79.81 v3(73.42,82.54)
  Bottom Layer w0.127: D3.1 72.9,79.43 R42.1 73.03,79.55 v3(76.15,79.55) ; U7.4 v2(77.93,79.3) ; v3(73.42,82.54) 72.98,82.09 72.98,81.57
$1N22838: length 41.7
  Bottom Layer w1: Q1.2 91.14,36.17 91.14,32.56 92.45,31.25 D1.1 95.92,31.25 104.47,39.8 104.47,50.6 103.08,52 103.08,55.04 103.33,55.3 103.34,55.29 105.25,55.29
$1N27929: length 9.5
  Inner2 w0.127: v2(28.65,74.93) 28.65,72.95 v2(28.53,72.82)
  Bottom Layer w0.127: U5.2 22.72,75.49 24.97,75.49 25.53,74.93 R48.1 v2(28.65,74.93) ; C61.2 28.4,72.7 v2(28.53,72.82)
$1N27982: length 4.6
  Bottom Layer w0.127: U5.13 15.85,75.52 R49.2 15.24,76.81 15.83,77.4 16.72,77.4 C60.2
$1N35424: length 12.3
  Bottom Layer w0.7: SPK1.2 59.67,86.69 56.32,83.35 L1.2 53.09,83.36 C62.2
$1N35429: length 5.1
  Bottom Layer w0.7: C62.1 51.25,85.97 L2.2
  Bottom Layer w1: SPK1.1 49.65,88.82 L2.2

## Copper pours and planes (outline as drawn; the poured copper is in the pictures)
GND on Bottom Layer: 81.62,27.61 107.52,27.61 107.52,1.71 81.62,1.71
GND on Bottom Layer: -1.06,111.05 109.81,111.05 109.81,-1.09 -1.06,-1.09
GND on Bottom Layer: 1.73,27.61 27.63,27.61 27.63,1.71 1.73,1.71
GND on Inner1: -6.14,110.03 111.08,110.03 111.08,-0.58 -6.14,-0.58
GND on Inner2: -1.19,110.67 109.81,110.67 109.81,-0.96 -1.19,-0.96
(no net) on Top Layer: 81.62,107.49 107.52,107.49 107.52,81.59 81.62,81.59
(no net) on Top Layer: 1.73,107.49 27.63,107.49 27.63,81.59 1.73,81.59
(no net) on Bottom Layer: 39.52,62 42.32,62 42.32,51.55 39.52,51.55
(no net) on Bottom Layer: 70.33,62.08 72.9,62.08 72.9,56.54 70.33,56.54
(no net) on Bottom Layer: 50.69,63.12 53.08,63.12 53.08,56.87 50.69,56.87
(no net) on Bottom Layer: 59.63,61.85 62.29,61.85 62.29,55.83 59.63,55.83
(no net) on Bottom Layer: 81.62,107.49 107.52,107.49 107.52,81.59 81.62,81.59
(no net) on Bottom Layer: 1.73,107.49 27.63,107.49 27.63,81.59 1.73,81.59
ADC0 on Top Layer: 81.62,27.61 107.52,27.61 107.52,1.71 81.62,1.71
ADC1 on Top Layer: 56.25,42.05 62.28,42.05 62.28,26.13 56.25,26.13
ADC1 on Top Layer: 46.21,41.9 55.55,41.9 55.55,26.28 46.21,26.28
ADC2 on Top Layer: 1.73,27.61 27.63,27.61 27.63,1.71 1.73,1.71
ADC3 on Top Layer: 51.43,17.53 57.7,17.53 57.7,8.23 51.43,8.23
ADC3 on Top Layer: 51.76,20.9 57.37,20.9 57.37,18.06 51.76,18.06
VSYS on Inner1: 2,69.27 103.46,69.27 103.46,39.42 2,39.42
$1N2554 on Bottom Layer: 51.77,7.39 57.24,7.39 57.24,1.45 51.77,1.45

Small or netless copper shapes (teardrops, artwork), in the pictures only: 62 on Top Layer
